# EAGLE schematic Resistor_Resistor (EAGLE 8.3.0), part 23 of 43
## Parts (continued)
R31538  10K  RESISTOR_0201  [0201]
R31539  10K  RESISTOR_0201  [0201]
R31540  10K  RESISTOR_0201  [0201]
R31541  10K  RESISTOR_0201  [0201]
R31542  10K  RESISTOR_0201  [0201]
R31543  10K  RESISTOR_0201  [0201]
R31544  10K  RESISTOR_0201  [0201]
R31545  10K  RESISTOR_0201  [0201]
R31546  10K  RESISTOR_0201  [0201]
R31547  10K  RESISTOR_0201  [0201]
R31548  10K  RESISTOR_0201  [0201]
R31549  10K  RESISTOR_0201  [0201]
R31550  10K  RESISTOR_0201  [0201]
R31551  10K  RESISTOR_0201  [0201]
R31552  10K  RESISTOR_0201  [0201]
R31553  10K  RESISTOR_0201  [0201]
R31554  10K  RESISTOR_0201  [0201]
R31555  10K  RESISTOR_0201  [0201]
R31556  10K  RESISTOR_0201  [0201]
R31557  10K  RESISTOR_0201  [0201]
R31558  10K  RESISTOR_0201  [0201]
R31559  10K  RESISTOR_0201  [0201]
R31560  10K  RESISTOR_0201  [0201]
R31561  10K  RESISTOR_0201  [0201]
R31562  10K  RESISTOR_0201  [0201]
R31563  10K  RESISTOR_0201  [0201]
R31564  10K  RESISTOR_0201  [0201]
R31565  10K  RESISTOR_0201  [0201]
R31566  10K  RESISTOR_0201  [0201]
R31567  10K  RESISTOR_0201  [0201]
R31568  10K  RESISTOR_0201  [0201]
R31569  10K  RESISTOR_0201  [0201]
R31570  10K  RESISTOR_0201  [0201]
R31571  10K  RESISTOR_0201  [0201]
R31572  10K  RESISTOR_0201  [0201]
R31573  10K  RESISTOR_0201  [0201]
R31574  10K  RESISTOR_0201  [0201]
R31575  10K  RESISTOR_0201  [0201]
R31576  10K  RESISTOR_0201  [0201]
R31577  10K  RESISTOR_0201  [0201]
R31578  10K  RESISTOR_0201  [0201]
R31579  10K  RESISTOR_0201  [0201]
R31580  10K  RESISTOR_0201  [0201]
R31581  10K  RESISTOR_0201  [0201]
R31582  10K  RESISTOR_0201  [0201]
R31583  10K  RESISTOR_0201  [0201]
R31584  10K  RESISTOR_0201  [0201]
R31585  10K  RESISTOR_0201  [0201]
R31586  10K  RESISTOR_0201  [0201]
R31587  10K  RESISTOR_0201  [0201]
R31588  10K  RESISTOR_0201  [0201]
R31589  10K  RESISTOR_0201  [0201]
R31590  10K  RESISTOR_0201  [0201]
R31591  10K  RESISTOR_0201  [0201]
R31592  10K  RESISTOR_0201  [0201]
R31593  10K  RESISTOR_0201  [0201]
R31594  10K  RESISTOR_0201  [0201]
R31595  10K  RESISTOR_0201  [0201]
R31596  10K  RESISTOR_0201  [0201]
R31597  10K  RESISTOR_0201  [0201]
R31598  10K  RESISTOR_0201  [0201]
R31599  10K  RESISTOR_0201  [0201]
R31600  10K  RESISTOR_0201  [0201]
R31601  10K  RESISTOR_0201  [0201]
R31602  10K  RESISTOR_0201  [0201]
R31603  10K  RESISTOR_0201  [0201]
R31604  10K  RESISTOR_0201  [0201]
R31605  10K  RESISTOR_0201  [0201]
R31606  10K  RESISTOR_0201  [0201]
R31607  10K  RESISTOR_0201  [0201]
R31608  10K  RESISTOR_0201  [0201]
R31609  10K  RESISTOR_0201  [0201]
R31610  10K  RESISTOR_0201  [0201]
R31611  10K  RESISTOR_0201  [0201]
R31612  10K  RESISTOR_0201  [0201]
R31613  10K  RESISTOR_0201  [0201]
R31614  10K  RESISTOR_0201  [0201]
R31615  10K  RESISTOR_0201  [0201]
R31616  10K  RESISTOR_0201  [0201]
R31617  10K  RESISTOR_0201  [0201]
R31618  10K  RESISTOR_0201  [0201]
R31619  10K  RESISTOR_0201  [0201]
R31620  10K  RESISTOR_0201  [0201]
R31621  10K  RESISTOR_0201  [0201]
R31622  10K  RESISTOR_0201  [0201]
R31623  10K  RESISTOR_0201  [0201]
R31624  10K  RESISTOR_0201  [0201]
R31625  10K  RESISTOR_0201  [0201]
R31626  10K  RESISTOR_0201  [0201]
R31627  10K  RESISTOR_0201  [0201]
R31628  10K  RESISTOR_0201  [0201]
R31629  10K  RESISTOR_0201  [0201]
R31630  10K  RESISTOR_0201  [0201]
R31631  10K  RESISTOR_0201  [0201]
R31632  10K  RESISTOR_0201  [0201]
R31633  10K  RESISTOR_0201  [0201]
R31634  10K  RESISTOR_0201  [0201]
R31635  10K  RESISTOR_0201  [0201]
R31636  10K  RESISTOR_0201  [0201]
R31637  10K  RESISTOR_0201  [0201]
R31638  10K  RESISTOR_0201  [0201]
R31639  10K  RESISTOR_0201  [0201]
R31640  10K  RESISTOR_0201  [0201]
R31641  10K  RESISTOR_0201  [0201]
R31642  10K  RESISTOR_0201  [0201]
R31643  10K  RESISTOR_0201  [0201]
R31644  10K  RESISTOR_0201  [0201]
R31645  10K  RESISTOR_0201  [0201]
R31646  10K  RESISTOR_0201  [0201]
R31647  10K  RESISTOR_0201  [0201]
R31648  10K  RESISTOR_0201  [0201]
R31649  10K  RESISTOR_0201  [0201]
R31650  10K  RESISTOR_0201  [0201]
R31651  10K  RESISTOR_0201  [0201]
R31652  10K  RESISTOR_0201  [0201]
R31653  10K  RESISTOR_0201  [0201]
R31654  10K  RESISTOR_0201  [0201]
R31655  10K  RESISTOR_0201  [0201]
R31656  10K  RESISTOR_0201  [0201]
R31657  10K  RESISTOR_0201  [0201]
R31658  10K  RESISTOR_0201  [0201]
R31659  10K  RESISTOR_0201  [0201]
R31660  10K  RESISTOR_0201  [0201]
R31661  10K  RESISTOR_0201  [0201]
R31662  10K  RESISTOR_0201  [0201]
R31663  10K  RESISTOR_0201  [0201]
R31664  10K  RESISTOR_0201  [0201]
R31665  10K  RESISTOR_0201  [0201]
R31666  10K  RESISTOR_0201  [0201]
R31667  10K  RESISTOR_0201  [0201]
R31668  10K  RESISTOR_0201  [0201]
R31669  10K  RESISTOR_0201  [0201]
R31670  10K  RESISTOR_0201  [0201]
R31671  10K  RESISTOR_0201  [0201]
R31672  10K  RESISTOR_0201  [0201]
R31673  10K  RESISTOR_0201  [0201]
R31674  10K  RESISTOR_0201  [0201]
R31675  10K  RESISTOR_0201  [0201]
R31676  10K  RESISTOR_0201  [0201]
R31677  10K  RESISTOR_0201  [0201]
R31678  10K  RESISTOR_0201  [0201]
R31679  10K  RESISTOR_0201  [0201]
R31680  10K  RESISTOR_0201  [0201]
R31681  10K  RESISTOR_0201  [0201]
R31682  10K  RESISTOR_0201  [0201]
R31683  10K  RESISTOR_0201  [0201]
R31684  10K  RESISTOR_0201  [0201]
R31685  10K  RESISTOR_0201  [0201]
R31686  10K  RESISTOR_0201  [0201]
R31687  10K  RESISTOR_0201  [0201]
R31688  10K  RESISTOR_0201  [0201]
R31689  10K  RESISTOR_0201  [0201]
R31690  10K  RESISTOR_0201  [0201]
R31691  10K  RESISTOR_0201  [0201]
R31692  10K  RESISTOR_0201  [0201]
R31693  10K  RESISTOR_0201  [0201]
R31694  10K  RESISTOR_0201  [0201]
R31695  10K  RESISTOR_0201  [0201]
R31696  10K  RESISTOR_0201  [0201]
R31697  10K  RESISTOR_0201  [0201]
R31698  10K  RESISTOR_0201  [0201]
R31699  10K  RESISTOR_0201  [0201]
R31700  10K  RESISTOR_0201  [0201]
R31701  10K  RESISTOR_0201  [0201]
R31702  10K  RESISTOR_0201  [0201]
R31703  10K  RESISTOR_0201  [0201]
R31704  10K  RESISTOR_0201  [0201]
R31705  10K  RESISTOR_0201  [0201]
R31706  10K  RESISTOR_0201  [0201]
R31707  10K  RESISTOR_0201  [0201]
R31708  10K  RESISTOR_0201  [0201]
R31709  10K  RESISTOR_0201  [0201]
R31710  10K  RESISTOR_0201  [0201]
R31711  10K  RESISTOR_0201  [0201]
R31712  10K  RESISTOR_0201  [0201]
R31713  10K  RESISTOR_0201  [0201]
R31714  10K  RESISTOR_0201  [0201]
R31715  10K  RESISTOR_0201  [0201]
R31716  10K  RESISTOR_0201  [0201]
R31717  10K  RESISTOR_0201  [0201]
R31718  10K  RESISTOR_0201  [0201]
R31719  10K  RESISTOR_0201  [0201]
R31720  10K  RESISTOR_0201  [0201]
R31721  10K  RESISTOR_0201  [0201]
R31722  10K  RESISTOR_0201  [0201]
R31723  10K  RESISTOR_0201  [0201]
R31724  10K  RESISTOR_0201  [0201]
R31725  10K  RESISTOR_0201  [0201]
R31726  10K  RESISTOR_0201  [0201]
R31727  10K  RESISTOR_0201  [0201]
R31728  10K  RESISTOR_0201  [0201]
R31729  10K  RESISTOR_0201  [0201]
R31730  10K  RESISTOR_0201  [0201]
R31731  10K  RESISTOR_0201  [0201]
R31732  10K  RESISTOR_0201  [0201]
R31733  10K  RESISTOR_0201  [0201]
R31734  10K  RESISTOR_0201  [0201]
R31735  10K  RESISTOR_0201  [0201]
R31736  10K  RESISTOR_0201  [0201]
R31737  10K  RESISTOR_0201  [0201]
R31738  10K  RESISTOR_0201  [0201]
R31739  10K  RESISTOR_0201  [0201]
R31740  10K  RESISTOR_0201  [0201]
R31741  10K  RESISTOR_0201  [0201]
R31742  10K  RESISTOR_0201  [0201]
R31743  10K  RESISTOR_0201  [0201]
R31744  10K  RESISTOR_0201  [0201]
R31745  10K  RESISTOR_0201  [0201]
R31746  10K  RESISTOR_0201  [0201]
R31747  10K  RESISTOR_0201  [0201]
R31748  10K  RESISTOR_0201  [0201]
R31749  10K  RESISTOR_0201  [0201]
R31750  10K  RESISTOR_0201  [0201]
R31751  10K  RESISTOR_0201  [0201]
R31752  10K  RESISTOR_0201  [0201]
R31753  10K  RESISTOR_0201  [0201]
R31754  10K  RESISTOR_0201  [0201]
R31755  10K  RESISTOR_0201  [0201]
R31756  10K  RESISTOR_0201  [0201]
R31757  10K  RESISTOR_0201  [0201]
R31758  10K  RESISTOR_0201  [0201]
R31759  10K  RESISTOR_0201  [0201]
R31760  10K  RESISTOR_0201  [0201]
R31761  10K  RESISTOR_0201  [0201]
R31762  10K  RESISTOR_0201  [0201]
R31763  10K  RESISTOR_0201  [0201]
R31764  10K  RESISTOR_0201  [0201]
R31765  10K  RESISTOR_0201  [0201]
R31766  10K  RESISTOR_0201  [0201]
R31767  10K  RESISTOR_0201  [0201]
R31768  10K  RESISTOR_0201  [0201]
R31769  10K  RESISTOR_0201  [0201]
R31770  10K  RESISTOR_0201  [0201]
R31771  10K  RESISTOR_0201  [0201]
R31772  10K  RESISTOR_0201  [0201]
R31773  10K  RESISTOR_0201  [0201]
R31774  10K  RESISTOR_0201  [0201]
R31775  10K  RESISTOR_0201  [0201]
R31776  10K  RESISTOR_0201  [0201]
R31777  10K  RESISTOR_0201  [0201]
R31778  10K  RESISTOR_0201  [0201]
R31779  10K  RESISTOR_0201  [0201]
R31780  10K  RESISTOR_0201  [0201]
R31781  10K  RESISTOR_0201  [0201]
R31782  10K  RESISTOR_0201  [0201]
R31783  10K  RESISTOR_0201  [0201]
R31784  10K  RESISTOR_0201  [0201]
R31785  10K  RESISTOR_0201  [0201]
R31786  10K  RESISTOR_0201  [0201]
R31787  10K  RESISTOR_0201  [0201]
R31788  10K  RESISTOR_0201  [0201]
R31789  10K  RESISTOR_0201  [0201]
R31790  10K  RESISTOR_0201  [0201]
R31791  10K  RESISTOR_0201  [0201]
R31792  10K  RESISTOR_0201  [0201]
R31793  10K  RESISTOR_0201  [0201]
R31794  10K  RESISTOR_0201  [0201]
R31795  10K  RESISTOR_0201  [0201]
R31796  10K  RESISTOR_0201  [0201]
R31797  10K  RESISTOR_0201  [0201]
R31798  10K  RESISTOR_0201  [0201]
R31799  10K  RESISTOR_0201  [0201]
R31800  10K  RESISTOR_0201  [0201]
R31801  10K  RESISTOR_0201  [0201]
R31802  10K  RESISTOR_0201  [0201]
R31803  10K  RESISTOR_0201  [0201]
R31804  10K  RESISTOR_0201  [0201]
R31805  10K  RESISTOR_0201  [0201]
R31806  10K  RESISTOR_0201  [0201]
R31807  10K  RESISTOR_0201  [0201]
R31808  10K  RESISTOR_0201  [0201]
R31809  10K  RESISTOR_0201  [0201]
R31810  10K  RESISTOR_0201  [0201]
R31811  10K  RESISTOR_0201  [0201]
R31812  10K  RESISTOR_0201  [0201]
R31813  10K  RESISTOR_0201  [0201]
R31814  10K  RESISTOR_0201  [0201]
R31815  10K  RESISTOR_0201  [0201]
R31816  10K  RESISTOR_0201  [0201]
R31817  10K  RESISTOR_0201  [0201]
R31818  10K  RESISTOR_0201  [0201]
R31819  10K  RESISTOR_0201  [0201]
R31820  10K  RESISTOR_0201  [0201]
R31821  10K  RESISTOR_0201  [0201]
R31822  10K  RESISTOR_0201  [0201]
R31823  10K  RESISTOR_0201  [0201]
R31824  10K  RESISTOR_0201  [0201]
R31825  10K  RESISTOR_0201  [0201]
R31826  10K  RESISTOR_0201  [0201]
R31827  10K  RESISTOR_0201  [0201]
R31828  10K  RESISTOR_0201  [0201]
R31829  10K  RESISTOR_0201  [0201]
R31830  10K  RESISTOR_0201  [0201]
R31831  10K  RESISTOR_0201  [0201]
R31832  10K  RESISTOR_0201  [0201]
R31833  10K  RESISTOR_0201  [0201]
R31834  10K  RESISTOR_0201  [0201]
R31835  10K  RESISTOR_0201  [0201]
R31836  10K  RESISTOR_0201  [0201]
R31837  10K  RESISTOR_0201  [0201]
R31838  10K  RESISTOR_0201  [0201]
R31839  10K  RESISTOR_0201  [0201]
R31840  10K  RESISTOR_0201  [0201]
R31841  10K  RESISTOR_0201  [0201]
R31842  10K  RESISTOR_0201  [0201]
R31843  10K  RESISTOR_0201  [0201]
R31844  10K  RESISTOR_0201  [0201]
R31845  10K  RESISTOR_0201  [0201]
R31846  10K  RESISTOR_0201  [0201]
R31847  10K  RESISTOR_0201  [0201]
R31848  10K  RESISTOR_0201  [0201]
R31849  10K  RESISTOR_0201  [0201]
R31850  10K  RESISTOR_0201  [0201]
R31851  10K  RESISTOR_0201  [0201]
R31852  10K  RESISTOR_0201  [0201]
R31853  10K  RESISTOR_0201  [0201]
R31854  10K  RESISTOR_0201  [0201]
R31855  10K  RESISTOR_0201  [0201]
R31856  10K  RESISTOR_0201  [0201]
R31857  10K  RESISTOR_0201  [0201]
R31858  10K  RESISTOR_0201  [0201]
R31859  10K  RESISTOR_0201  [0201]
R31860  10K  RESISTOR_0201  [0201]
R31861  10K  RESISTOR_0201  [0201]
R31862  10K  RESISTOR_0201  [0201]
R31863  10K  RESISTOR_0201  [0201]
R31864  10K  RESISTOR_0201  [0201]
R31865  10K  RESISTOR_0201  [0201]
R31866  10K  RESISTOR_0201  [0201]
R31867  10K  RESISTOR_0201  [0201]
R31868  10K  RESISTOR_0201  [0201]
R31869  10K  RESISTOR_0201  [0201]
R31870  10K  RESISTOR_0201  [0201]
R31871  10K  RESISTOR_0201  [0201]
R31872  10K  RESISTOR_0201  [0201]
R31873  10K  RESISTOR_0201  [0201]
R31874  10K  RESISTOR_0201  [0201]
R31875  10K  RESISTOR_0201  [0201]
R31876  10K  RESISTOR_0201  [0201]
R31877  10K  RESISTOR_0201  [0201]
R31878  10K  RESISTOR_0201  [0201]
R31879  10K  RESISTOR_0201  [0201]
R31880  10K  RESISTOR_0201  [0201]
R31881  10K  RESISTOR_0201  [0201]
R31882  10K  RESISTOR_0201  [0201]
R31883  10K  RESISTOR_0201  [0201]
R31884  10K  RESISTOR_0201  [0201]
R31885  10K  RESISTOR_0201  [0201]
R31886  10K  RESISTOR_0201  [0201]
R31887  10K  RESISTOR_0201  [0201]
R31888  10K  RESISTOR_0201  [0201]
R31889  10K  RESISTOR_0201  [0201]
R31890  10K  RESISTOR_0201  [0201]
R31891  10K  RESISTOR_0201  [0201]
R31892  10K  RESISTOR_0201  [0201]
R31893  10K  RESISTOR_0201  [0201]
R31894  10K  RESISTOR_0201  [0201]
R31895  10K  RESISTOR_0201  [0201]
R31896  10K  RESISTOR_0201  [0201]
R31897  10K  RESISTOR_0201  [0201]
R31898  10K  RESISTOR_0201  [0201]
R31899  10K  RESISTOR_0201  [0201]
R31900  10K  RESISTOR_0201  [0201]
R31901  10K  RESISTOR_0201  [0201]
R31902  10K  RESISTOR_0201  [0201]
R31903  10K  RESISTOR_0201  [0201]
R31904  10K  RESISTOR_0201  [0201]
R31905  10K  RESISTOR_0201  [0201]
R31906  10K  RESISTOR_0201  [0201]
R31907  10K  RESISTOR_0201  [0201]
R31908  10K  RESISTOR_0201  [0201]
R31909  10K  RESISTOR_0201  [0201]
R31910  10K  RESISTOR_0201  [0201]
R31911  10K  RESISTOR_0201  [0201]
R31912  10K  RESISTOR_0201  [0201]
R31913  10K  RESISTOR_0201  [0201]
R31914  10K  RESISTOR_0201  [0201]
R31915  10K  RESISTOR_0201  [0201]
R31916  10K  RESISTOR_0201  [0201]
R31917  10K  RESISTOR_0201  [0201]
R31918  10K  RESISTOR_0201  [0201]
R31919  10K  RESISTOR_0201  [0201]
R31920  10K  RESISTOR_0201  [0201]
R31921  10K  RESISTOR_0201  [0201]
R31922  10K  RESISTOR_0201  [0201]
R31923  10K  RESISTOR_0201  [0201]
R31924  10K  RESISTOR_0201  [0201]
R31925  10K  RESISTOR_0201  [0201]
R31926  10K  RESISTOR_0201  [0201]
R31927  10K  RESISTOR_0201  [0201]
R31928  10K  RESISTOR_0201  [0201]
R31929  10K  RESISTOR_0201  [0201]
R31930  10K  RESISTOR_0201  [0201]
R31931  10K  RESISTOR_0201  [0201]
R31932  10K  RESISTOR_0201  [0201]
R31933  10K  RESISTOR_0201  [0201]
R31934  10K  RESISTOR_0201  [0201]
R31935  10K  RESISTOR_0201  [0201]
R31936  10K  RESISTOR_0201  [0201]
R31937  10K  RESISTOR_0201  [0201]
R31938  10K  RESISTOR_0201  [0201]
R31939  10K  RESISTOR_0201  [0201]
R31940  10K  RESISTOR_0201  [0201]
R31941  10K  RESISTOR_0201  [0201]
R31942  10K  RESISTOR_0201  [0201]
R31943  10K  RESISTOR_0201  [0201]
R31944  10K  RESISTOR_0201  [0201]
R31945  10K  RESISTOR_0201  [0201]
R31946  10K  RESISTOR_0201  [0201]
R31947  10K  RESISTOR_0201  [0201]
R31948  10K  RESISTOR_0201  [0201]
R31949  10K  RESISTOR_0201  [0201]
R31950  10K  RESISTOR_0201  [0201]
R31951  10K  RESISTOR_0201  [0201]
R31952  10K  RESISTOR_0201  [0201]
R31953  10K  RESISTOR_0201  [0201]
R31954  10K  RESISTOR_0201  [0201]
R31955  10K  RESISTOR_0201  [0201]
R31956  10K  RESISTOR_0201  [0201]
R31957  10K  RESISTOR_0201  [0201]
R31958  10K  RESISTOR_0201  [0201]
R31959  10K  RESISTOR_0201  [0201]
R31960  10K  RESISTOR_0201  [0201]
R31961  10K  RESISTOR_0201  [0201]
R31962  10K  RESISTOR_0201  [0201]
R31963  10K  RESISTOR_0201  [0201]
R31964  10K  RESISTOR_0201  [0201]
R31965  10K  RESISTOR_0201  [0201]
R31966  10K  RESISTOR_0201  [0201]
R31967  10K  RESISTOR_0201  [0201]
R31968  10K  RESISTOR_0201  [0201]
R31969  10K  RESISTOR_0201  [0201]
R31970  10K  RESISTOR_0201  [0201]
R31971  10K  RESISTOR_0201  [0201]
R31972  10K  RESISTOR_0201  [0201]
R31973  10K  RESISTOR_0201  [0201]
R31974  10K  RESISTOR_0201  [0201]
R31975  10K  RESISTOR_0201  [0201]
R31976  10K  RESISTOR_0201  [0201]
R31977  10K  RESISTOR_0201  [0201]
R31978  10K  RESISTOR_0201  [0201]
R31979  10K  RESISTOR_0201  [0201]
R31980  10K  RESISTOR_0201  [0201]
R31981  10K  RESISTOR_0201  [0201]
R31982  10K  RESISTOR_0201  [0201]
R31983  10K  RESISTOR_0201  [0201]
R31984  10K  RESISTOR_0201  [0201]
R31985  10K  RESISTOR_0201  [0201]
R31986  10K  RESISTOR_0201  [0201]
R31987  10K  RESISTOR_0201  [0201]
R31988  10K  RESISTOR_0201  [0201]
R31989  10K  RESISTOR_0201  [0201]
R31990  10K  RESISTOR_0201  [0201]
R31991  10K  RESISTOR_0201  [0201]
R31992  10K  RESISTOR_0201  [0201]
R31993  10K  RESISTOR_0201  [0201]
R31994  10K  RESISTOR_0201  [0201]
R31995  10K  RESISTOR_0201  [0201]
R31996  10K  RESISTOR_0201  [0201]
R31997  10K  RESISTOR_0201  [0201]
R31998  10K  RESISTOR_0201  [0201]
R31999  10K  RESISTOR_0201  [0201]
R32000  10K  RESISTOR_0201  [0201]
R32001  10K  RESISTOR_0201  [0201]
R32002  10K  RESISTOR_0201  [0201]
R32003  10K  RESISTOR_0201  [0201]
R32004  10K  RESISTOR_0201  [0201]
R32005  10K  RESISTOR_0201  [0201]
R32006  10K  RESISTOR_0201  [0201]
R32007  10K  RESISTOR_0201  [0201]
R32008  10K  RESISTOR_0201  [0201]
R32009  10K  RESISTOR_0201  [0201]
R32010  10K  RESISTOR_0201  [0201]
R32011  10K  RESISTOR_0201  [0201]
R32012  10K  RESISTOR_0201  [0201]
R32013  10K  RESISTOR_0201  [0201]
R32014  10K  RESISTOR_0201  [0201]
R32015  10K  RESISTOR_0201  [0201]
R32016  10K  RESISTOR_0201  [0201]
R32017  10K  RESISTOR_0201  [0201]
R32018  10K  RESISTOR_0201  [0201]
R32019  10K  RESISTOR_0201  [0201]
R32020  10K  RESISTOR_0201  [0201]
R32021  10K  RESISTOR_0201  [0201]
R32022  10K  RESISTOR_0201  [0201]
R32023  10K  RESISTOR_0201  [0201]
R32024  10K  RESISTOR_0201  [0201]
R32025  10K  RESISTOR_0201  [0201]
R32026  10K  RESISTOR_0201  [0201]
R32027  10K  RESISTOR_0201  [0201]
R32028  10K  RESISTOR_0201  [0201]
R32029  10K  RESISTOR_0201  [0201]
R32030  10K  RESISTOR_0201  [0201]
R32031  10K  RESISTOR_0201  [0201]
R32032  10K  RESISTOR_0201  [0201]
R32033  10K  RESISTOR_0201  [0201]
R32034  10K  RESISTOR_0201  [0201]
R32035  10K  RESISTOR_0201  [0201]
R32036  10K  RESISTOR_0201  [0201]
R32037  10K  RESISTOR_0201  [0201]
R32038  10K  RESISTOR_0201  [0201]
R32039  10K  RESISTOR_0201  [0201]
R32040  10K  RESISTOR_0201  [0201]
R32041  10K  RESISTOR_0201  [0201]
R32042  10K  RESISTOR_0201  [0201]
R32043  10K  RESISTOR_0201  [0201]
R32044  10K  RESISTOR_0201  [0201]
R32045  10K  RESISTOR_0201  [0201]
R32046  10K  RESISTOR_0201  [0201]
R32047  10K  RESISTOR_0201  [0201]
R32048  10K  RESISTOR_0201  [0201]
R32049  10K  RESISTOR_0201  [0201]
R32050  10K  RESISTOR_0201  [0201]
R32051  10K  RESISTOR_0201  [0201]
R32052  10K  RESISTOR_0201  [0201]
R32053  10K  RESISTOR_0201  [0201]
R32054  10K  RESISTOR_0201  [0201]
R32055  10K  RESISTOR_0201  [0201]
R32056  10K  RESISTOR_0201  [0201]
R32057  10K  RESISTOR_0201  [0201]
R32058  10K  RESISTOR_0201  [0201]
R32059  10K  RESISTOR_0201  [0201]
R32060  10K  RESISTOR_0201  [0201]
R32061  10K  RESISTOR_0201  [0201]
R32062  10K  RESISTOR_0201  [0201]
R32063  10K  RESISTOR_0201  [0201]
R32064  10K  RESISTOR_0201  [0201]
R32065  10K  RESISTOR_0201  [0201]
R32066  10K  RESISTOR_0201  [0201]
R32067  10K  RESISTOR_0201  [0201]
R32068  10K  RESISTOR_0201  [0201]
R32069  10K  RESISTOR_0201  [0201]
R32070  10K  RESISTOR_0201  [0201]
R32071  10K  RESISTOR_0201  [0201]
R32072  10K  RESISTOR_0201  [0201]
R32073  10K  RESISTOR_0201  [0201]
R32074  10K  RESISTOR_0201  [0201]
R32075  10K  RESISTOR_0201  [0201]
R32076  10K  RESISTOR_0201  [0201]
R32077  10K  RESISTOR_0201  [0201]
R32078  10K  RESISTOR_0201  [0201]
R32079  10K  RESISTOR_0201  [0201]
R32080  10K  RESISTOR_0201  [0201]
R32081  10K  RESISTOR_0201  [0201]
R32082  10K  RESISTOR_0201  [0201]
R32083  10K  RESISTOR_0201  [0201]
R32084  10K  RESISTOR_0201  [0201]
R32085  10K  RESISTOR_0201  [0201]
R32086  10K  RESISTOR_0201  [0201]
R32087  10K  RESISTOR_0201  [0201]
R32088  10K  RESISTOR_0201  [0201]
R32089  10K  RESISTOR_0201  [0201]
R32090  10K  RESISTOR_0201  [0201]
R32091  10K  RESISTOR_0201  [0201]
R32092  10K  RESISTOR_0201  [0201]
R32093  10K  RESISTOR_0201  [0201]
R32094  10K  RESISTOR_0201  [0201]
R32095  10K  RESISTOR_0201  [0201]
R32096  10K  RESISTOR_0201  [0201]
R32097  10K  RESISTOR_0201  [0201]
R32098  10K  RESISTOR_0201  [0201]
R32099  10K  RESISTOR_0201  [0201]
R32100  10K  RESISTOR_0201  [0201]
R32101  10K  RESISTOR_0201  [0201]
R32102  10K  RESISTOR_0201  [0201]
R32103  10K  RESISTOR_0201  [0201]
R32104  10K  RESISTOR_0201  [0201]
R32105  10K  RESISTOR_0201  [0201]
R32106  10K  RESISTOR_0201  [0201]
R32107  10K  RESISTOR_0201  [0201]
R32108  10K  RESISTOR_0201  [0201]
R32109  10K  RESISTOR_0201  [0201]
R32110  10K  RESISTOR_0201  [0201]
R32111  10K  RESISTOR_0201  [0201]
R32112  10K  RESISTOR_0201  [0201]
R32113  10K  RESISTOR_0201  [0201]
R32114  10K  RESISTOR_0201  [0201]
R32115  10K  RESISTOR_0201  [0201]
R32116  10K  RESISTOR_0201  [0201]
R32117  10K  RESISTOR_0201  [0201]
R32118  10K  RESISTOR_0201  [0201]
R32119  10K  RESISTOR_0201  [0201]
R32120  10K  RESISTOR_0201  [0201]
R32121  10K  RESISTOR_0201  [0201]
R32122  10K  RESISTOR_0201  [0201]
R32123  10K  RESISTOR_0201  [0201]
R32124  10K  RESISTOR_0201  [0201]
R32125  10K  RESISTOR_0201  [0201]
R32126  10K  RESISTOR_0201  [0201]
R32127  10K  RESISTOR_0201  [0201]
R32128  10K  RESISTOR_0201  [0201]
R32129  10K  RESISTOR_0201  [0201]
R32130  10K  RESISTOR_0201  [0201]
R32131  10K  RESISTOR_0201  [0201]
R32132  10K  RESISTOR_0201  [0201]
R32133  10K  RESISTOR_0201  [0201]
R32134  10K  RESISTOR_0201  [0201]
R32135  10K  RESISTOR_0201  [0201]
R32136  10K  RESISTOR_0201  [0201]
R32137  10K  RESISTOR_0201  [0201]
R32138  10K  RESISTOR_0201  [0201]
R32139  10K  RESISTOR_0201  [0201]
R32140  10K  RESISTOR_0201  [0201]
R32141  10K  RESISTOR_0201  [0201]
R32142  10K  RESISTOR_0201  [0201]
R32143  10K  RESISTOR_0201  [0201]
R32144  10K  RESISTOR_0201  [0201]
R32145  10K  RESISTOR_0201  [0201]
R32146  10K  RESISTOR_0201  [0201]
R32147  10K  RESISTOR_0201  [0201]
R32148  10K  RESISTOR_0201  [0201]
R32149  10K  RESISTOR_0201  [0201]
R32150  10K  RESISTOR_0201  [0201]
R32151  10K  RESISTOR_0201  [0201]
R32152  10K  RESISTOR_0201  [0201]
R32153  10K  RESISTOR_0201  [0201]
R32154  10K  RESISTOR_0201  [0201]
R32155  10K  RESISTOR_0201  [0201]
R32156  10K  RESISTOR_0201  [0201]
R32157  10K  RESISTOR_0201  [0201]
R32158  10K  RESISTOR_0201  [0201]
R32159  10K  RESISTOR_0201  [0201]
R32160  10K  RESISTOR_0201  [0201]
R32161  10K  RESISTOR_0201  [0201]
R32162  10K  RESISTOR_0201  [0201]
R32163  10K  RESISTOR_0201  [0201]
R32164  10K  RESISTOR_0201  [0201]
R32165  10K  RESISTOR_0201  [0201]
R32166  10K  RESISTOR_0201  [0201]
R32167  10K  RESISTOR_0201  [0201]
R32168  10K  RESISTOR_0201  [0201]
R32169  10K  RESISTOR_0201  [0201]
R32170  10K  RESISTOR_0201  [0201]
R32171  10K  RESISTOR_0201  [0201]
R32172  10K  RESISTOR_0201  [0201]
R32173  10K  RESISTOR_0201  [0201]
R32174  10K  RESISTOR_0201  [0201]
R32175  10K  RESISTOR_0201  [0201]
R32176  10K  RESISTOR_0201  [0201]
R32177  10K  RESISTOR_0201  [0201]
R32178  10K  RESISTOR_0201  [0201]
R32179  10K  RESISTOR_0201  [0201]
R32180  10K  RESISTOR_0201  [0201]
R32181  10K  RESISTOR_0201  [0201]
R32182  10K  RESISTOR_0201  [0201]
R32183  10K  RESISTOR_0201  [0201]
R32184  10K  RESISTOR_0201  [0201]
R32185  10K  RESISTOR_0201  [0201]
R32186  10K  RESISTOR_0201  [0201]
R32187  10K  RESISTOR_0201  [0201]
R32188  10K  RESISTOR_0201  [0201]
R32189  10K  RESISTOR_0201  [0201]
R32190  10K  RESISTOR_0201  [0201]
R32191  10K  RESISTOR_0201  [0201]
R32192  10K  RESISTOR_0201  [0201]
R32193  10K  RESISTOR_0201  [0201]
R32194  10K  RESISTOR_0201  [0201]
R32195  10K  RESISTOR_0201  [0201]
R32196  10K  RESISTOR_0201  [0201]
R32197  10K  RESISTOR_0201  [0201]
R32198  10K  RESISTOR_0201  [0201]
R32199  10K  RESISTOR_0201  [0201]
R32200  10K  RESISTOR_0201  [0201]
R32201  10K  RESISTOR_0201  [0201]
R32202  10K  RESISTOR_0201  [0201]
R32203  10K  RESISTOR_0201  [0201]
R32204  10K  RESISTOR_0201  [0201]
R32205  10K  RESISTOR_0201  [0201]
R32206  10K  RESISTOR_0201  [0201]
R32207  10K  RESISTOR_0201  [0201]
R32208  10K  RESISTOR_0201  [0201]
R32209  10K  RESISTOR_0201  [0201]
R32210  10K  RESISTOR_0201  [0201]
R32211  10K  RESISTOR_0201  [0201]
R32212  10K  RESISTOR_0201  [0201]
R32213  10K  RESISTOR_0201  [0201]
R32214  10K  RESISTOR_0201  [0201]
R32215  10K  RESISTOR_0201  [0201]
R32216  10K  RESISTOR_0201  [0201]
R32217  10K  RESISTOR_0201  [0201]
R32218  10K  RESISTOR_0201  [0201]
R32219  10K  RESISTOR_0201  [0201]
R32220  10K  RESISTOR_0201  [0201]
R32221  10K  RESISTOR_0201  [0201]
R32222  10K  RESISTOR_0201  [0201]
R32223  10K  RESISTOR_0201  [0201]
R32224  10K  RESISTOR_0201  [0201]
R32225  10K  RESISTOR_0201  [0201]
R32226  10K  RESISTOR_0201  [0201]
R32227  10K  RESISTOR_0201  [0201]
R32228  10K  RESISTOR_0201  [0201]
R32229  10K  RESISTOR_0201  [0201]
R32230  10K  RESISTOR_0201  [0201]
R32231  10K  RESISTOR_0201  [0201]
R32232  10K  RESISTOR_0201  [0201]
R32233  10K  RESISTOR_0201  [0201]
R32234  10K  RESISTOR_0201  [0201]
R32235  10K  RESISTOR_0201  [0201]
R32236  10K  RESISTOR_0201  [0201]
R32237  10K  RESISTOR_0201  [0201]
R32238  10K  RESISTOR_0201  [0201]
R32239  10K  RESISTOR_0201  [0201]
R32240  10K  RESISTOR_0201  [0201]
R32241  10K  RESISTOR_0201  [0201]
R32242  10K  RESISTOR_0201  [0201]
R32243  10K  RESISTOR_0201  [0201]
R32244  10K  RESISTOR_0201  [0201]
R32245  10K  RESISTOR_0201  [0201]
R32246  10K  RESISTOR_0201  [0201]
R32247  10K  RESISTOR_0201  [0201]
R32248  10K  RESISTOR_0201  [0201]
R32249  10K  RESISTOR_0201  [0201]
R32250  10K  RESISTOR_0201  [0201]
R32251  10K  RESISTOR_0201  [0201]
R32252  10K  RESISTOR_0201  [0201]
R32253  10K  RESISTOR_0201  [0201]
R32254  10K  RESISTOR_0201  [0201]
R32255  10K  RESISTOR_0201  [0201]
R32256  10K  RESISTOR_0201  [0201]
R32257  10K  RESISTOR_0201  [0201]
R32258  10K  RESISTOR_0201  [0201]
R32259  10K  RESISTOR_0201  [0201]
R32260  10K  RESISTOR_0201  [0201]
R32261  10K  RESISTOR_0201  [0201]
R32262  10K  RESISTOR_0201  [0201]
R32263  10K  RESISTOR_0201  [0201]
R32264  10K  RESISTOR_0201  [0201]
R32265  10K  RESISTOR_0201  [0201]
R32266  10K  RESISTOR_0201  [0201]
R32267  10K  RESISTOR_0201  [0201]
R32268  10K  RESISTOR_0201  [0201]
R32269  10K  RESISTOR_0201  [0201]
R32270  10K  RESISTOR_0201  [0201]
R32271  10K  RESISTOR_0201  [0201]
R32272  10K  RESISTOR_0201  [0201]
R32273  10K  RESISTOR_0201  [0201]
R32274  10K  RESISTOR_0201  [0201]
R32275  10K  RESISTOR_0201  [0201]
R32276  10K  RESISTOR_0201  [0201]
R32277  10K  RESISTOR_0201  [0201]
R32278  10K  RESISTOR_0201  [0201]
R32279  10K  RESISTOR_0201  [0201]
R32280  10K  RESISTOR_0201  [0201]
R32281  10K  RESISTOR_0201  [0201]
R32282  10K  RESISTOR_0201  [0201]
R32283  10K  RESISTOR_0201  [0201]
R32284  10K  RESISTOR_0201  [0201]
R32285  10K  RESISTOR_0201  [0201]
R32286  10K  RESISTOR_0201  [0201]
R32287  10K  RESISTOR_0201  [0201]
R32288  10K  RESISTOR_0201  [0201]
R32289  10K  RESISTOR_0201  [0201]
R32290  10K  RESISTOR_0201  [0201]
R32291  10K  RESISTOR_0201  [0201]
R32292  10K  RESISTOR_0201  [0201]
R32293  10K  RESISTOR_0201  [0201]
R32294  10K  RESISTOR_0201  [0201]
R32295  10K  RESISTOR_0201  [0201]
R32296  10K  RESISTOR_0201  [0201]
R32297  10K  RESISTOR_0201  [0201]
R32298  10K  RESISTOR_0201  [0201]
R32299  10K  RESISTOR_0201  [0201]
R32300  10K  RESISTOR_0201  [0201]
R32301  10K  RESISTOR_0201  [0201]
R32302  10K  RESISTOR_0201  [0201]
R32303  10K  RESISTOR_0201  [0201]
R32304  10K  RESISTOR_0201  [0201]
R32305  10K  RESISTOR_0201  [0201]
R32306  10K  RESISTOR_0201  [0201]
R32307  10K  RESISTOR_0201  [0201]
R32308  10K  RESISTOR_0201  [0201]
R32309  10K  RESISTOR_0201  [0201]
R32310  10K  RESISTOR_0201  [0201]
R32311  10K  RESISTOR_0201  [0201]
R32312  10K  RESISTOR_0201  [0201]
R32313  10K  RESISTOR_0201  [0201]
R32314  10K  RESISTOR_0201  [0201]
R32315  10K  RESISTOR_0201  [0201]
R32316  10K  RESISTOR_0201  [0201]
R32317  10K  RESISTOR_0201  [0201]
R32318  10K  RESISTOR_0201  [0201]
R32319  10K  RESISTOR_0201  [0201]
R32320  10K  RESISTOR_0201  [0201]
R32321  10K  RESISTOR_0201  [0201]
R32322  10K  RESISTOR_0201  [0201]
R32323  10K  RESISTOR_0201  [0201]
R32324  10K  RESISTOR_0201  [0201]
R32325  10K  RESISTOR_0201  [0201]
R32326  10K  RESISTOR_0201  [0201]
R32327  10K  RESISTOR_0201  [0201]
R32328  10K  RESISTOR_0201  [0201]
R32329  10K  RESISTOR_0201  [0201]
R32330  10K  RESISTOR_0201  [0201]
R32331  10K  RESISTOR_0201  [0201]
R32332  10K  RESISTOR_0201  [0201]
R32333  10K  RESISTOR_0201  [0201]
R32334  10K  RESISTOR_0201  [0201]
R32335  10K  RESISTOR_0201  [0201]
R32336  10K  RESISTOR_0201  [0201]
R32337  10K  RESISTOR_0201  [0201]
R32338  10K  RESISTOR_0201  [0201]
R32339  10K  RESISTOR_0201  [0201]
R32340  10K  RESISTOR_0201  [0201]
R32341  10K  RESISTOR_0201  [0201]
R32342  10K  RESISTOR_0201  [0201]
R32343  10K  RESISTOR_0201  [0201]
R32344  10K  RESISTOR_0201  [0201]
R32345  10K  RESISTOR_0201  [0201]
R32346  10K  RESISTOR_0201  [0201]
R32347  10K  RESISTOR_0201  [0201]
R32348  10K  RESISTOR_0201  [0201]
R32349  10K  RESISTOR_0201  [0201]
R32350  10K  RESISTOR_0201  [0201]
R32351  10K  RESISTOR_0201  [0201]
R32352  10K  RESISTOR_0201  [0201]
R32353  10K  RESISTOR_0201  [0201]
R32354  10K  RESISTOR_0201  [0201]
R32355  10K  RESISTOR_0201  [0201]
R32356  10K  RESISTOR_0201  [0201]
R32357  10K  RESISTOR_0201  [0201]
R32358  10K  RESISTOR_0201  [0201]
R32359  10K  RESISTOR_0201  [0201]
R32360  10K  RESISTOR_0201  [0201]
R32361  10K  RESISTOR_0201  [0201]
R32362  10K  RESISTOR_0201  [0201]
R32363  10K  RESISTOR_0201  [0201]
R32364  10K  RESISTOR_0201  [0201]
R32365  10K  RESISTOR_0201  [0201]
R32366  10K  RESISTOR_0201  [0201]
R32367  10K  RESISTOR_0201  [0201]
R32368  10K  RESISTOR_0201  [0201]
R32369  10K  RESISTOR_0201  [0201]
R32370  10K  RESISTOR_0201  [0201]
R32371  10K  RESISTOR_0201  [0201]
R32372  10K  RESISTOR_0201  [0201]
R32373  10K  RESISTOR_0201  [0201]
R32374  10K  RESISTOR_0201  [0201]
R32375  10K  RESISTOR_0201  [0201]
R32376  10K  RESISTOR_0201  [0201]
R32377  10K  RESISTOR_0201  [0201]
R32378  10K  RESISTOR_0201  [0201]
R32379  10K  RESISTOR_0201  [0201]
R32380  10K  RESISTOR_0201  [0201]
R32381  10K  RESISTOR_0201  [0201]
R32382  10K  RESISTOR_0201  [0201]
R32383  10K  RESISTOR_0201  [0201]
R32384  10K  RESISTOR_0201  [0201]
R32385  10K  RESISTOR_0201  [0201]
R32386  10K  RESISTOR_0201  [0201]
R32387  10K  RESISTOR_0201  [0201]
R32388  10K  RESISTOR_0201  [0201]
R32389  10K  RESISTOR_0201  [0201]
R32390  10K  RESISTOR_0201  [0201]
R32391  10K  RESISTOR_0201  [0201]
R32392  10K  RESISTOR_0201  [0201]
R32393  10K  RESISTOR_0201  [0201]
R32394  10K  RESISTOR_0201  [0201]
R32395  10K  RESISTOR_0201  [0201]
R32396  10K  RESISTOR_0201  [0201]
R32397  10K  RESISTOR_0201  [0201]
R32398  10K  RESISTOR_0201  [0201]
R32399  10K  RESISTOR_0201  [0201]
R32400  10K  RESISTOR_0201  [0201]
R32401  10K  RESISTOR_0201  [0201]
R32402  10K  RESISTOR_0201  [0201]
R32403  10K  RESISTOR_0201  [0201]
R32404  10K  RESISTOR_0201  [0201]
R32405  10K  RESISTOR_0201  [0201]
R32406  10K  RESISTOR_0201  [0201]
R32407  10K  RESISTOR_0201  [0201]
R32408  10K  RESISTOR_0201  [0201]
R32409  10K  RESISTOR_0201  [0201]
R32410  10K  RESISTOR_0201  [0201]
R32411  10K  RESISTOR_0201  [0201]
R32412  10K  RESISTOR_0201  [0201]
R32413  10K  RESISTOR_0201  [0201]
R32414  10K  RESISTOR_0201  [0201]
R32415  10K  RESISTOR_0201  [0201]
R32416  10K  RESISTOR_0201  [0201]
R32417  10K  RESISTOR_0201  [0201]
R32418  10K  RESISTOR_0201  [0201]
R32419  10K  RESISTOR_0201  [0201]
R32420  10K  RESISTOR_0201  [0201]
R32421  10K  RESISTOR_0201  [0201]
R32422  10K  RESISTOR_0201  [0201]
R32423  10K  RESISTOR_0201  [0201]
R32424  10K  RESISTOR_0201  [0201]
R32425  10K  RESISTOR_0201  [0201]
R32426  10K  RESISTOR_0201  [0201]
R32427  10K  RESISTOR_0201  [0201]
R32428  10K  RESISTOR_0201  [0201]
R32429  10K  RESISTOR_0201  [0201]
R32430  10K  RESISTOR_0201  [0201]
R32431  10K  RESISTOR_0201  [0201]
R32432  10K  RESISTOR_0201  [0201]
R32433  10K  RESISTOR_0201  [0201]
R32434  10K  RESISTOR_0201  [0201]
R32435  10K  RESISTOR_0201  [0201]
R32436  10K  RESISTOR_0201  [0201]
R32437  10K  RESISTOR_0201  [0201]
R32438  10K  RESISTOR_0201  [0201]
R32439  10K  RESISTOR_0201  [0201]
R32440  10K  RESISTOR_0201  [0201]
R32441  10K  RESISTOR_0201  [0201]
R32442  10K  RESISTOR_0201  [0201]
R32443  10K  RESISTOR_0201  [0201]
R32444  10K  RESISTOR_0201  [0201]
R32445  10K  RESISTOR_0201  [0201]
R32446  10K  RESISTOR_0201  [0201]
R32447  10K  RESISTOR_0201  [0201]
R32448  10K  RESISTOR_0201  [0201]
R32449  10K  RESISTOR_0201  [0201]
R32450  10K  RESISTOR_0201  [0201]
R32451  10K  RESISTOR_0201  [0201]
R32452  10K  RESISTOR_0201  [0201]
R32453  10K  RESISTOR_0201  [0201]
R32454  10K  RESISTOR_0201  [0201]
R32455  10K  RESISTOR_0201  [0201]
R32456  10K  RESISTOR_0201  [0201]
R32457  10K  RESISTOR_0201  [0201]
R32458  10K  RESISTOR_0201  [0201]
R32459  10K  RESISTOR_0201  [0201]
R32460  10K  RESISTOR_0201  [0201]
R32461  10K  RESISTOR_0201  [0201]
R32462  10K  RESISTOR_0201  [0201]
R32463  10K  RESISTOR_0201  [0201]
R32464  10K  RESISTOR_0201  [0201]
R32465  10K  RESISTOR_0201  [0201]
R32466  10K  RESISTOR_0201  [0201]
R32467  10K  RESISTOR_0201  [0201]
R32468  10K  RESISTOR_0201  [0201]
R32469  10K  RESISTOR_0201  [0201]
R32470  10K  RESISTOR_0201  [0201]
R32471  10K  RESISTOR_0201  [0201]
R32472  10K  RESISTOR_0201  [0201]
R32473  10K  RESISTOR_0201  [0201]
R32474  10K  RESISTOR_0201  [0201]
R32475  10K  RESISTOR_0201  [0201]
R32476  10K  RESISTOR_0201  [0201]
R32477  10K  RESISTOR_0201  [0201]
R32478  10K  RESISTOR_0201  [0201]
R32479  10K  RESISTOR_0201  [0201]
R32480  10K  RESISTOR_0201  [0201]
R32481  10K  RESISTOR_0201  [0201]
R32482  10K  RESISTOR_0201  [0201]
R32483  10K  RESISTOR_0201  [0201]
R32484  10K  RESISTOR_0201  [0201]
R32485  10K  RESISTOR_0201  [0201]
R32486  10K  RESISTOR_0201  [0201]
R32487  10K  RESISTOR_0201  [0201]
R32488  10K  RESISTOR_0201  [0201]
R32489  10K  RESISTOR_0201  [0201]
R32490  10K  RESISTOR_0201  [0201]
R32491  10K  RESISTOR_0201  [0201]
R32492  10K  RESISTOR_0201  [0201]
R32493  10K  RESISTOR_0201  [0201]
R32494  10K  RESISTOR_0201  [0201]
R32495  10K  RESISTOR_0201  [0201]
R32496  10K  RESISTOR_0201  [0201]
R32497  10K  RESISTOR_0201  [0201]
R32498  10K  RESISTOR_0201  [0201]
R32499  10K  RESISTOR_0201  [0201]
R32500  10K  RESISTOR_0201  [0201]
R32501  10K  RESISTOR_0201  [0201]
R32502  10K  RESISTOR_0201  [0201]
R32503  10K  RESISTOR_0201  [0201]
R32504  10K  RESISTOR_0201  [0201]
R32505  10K  RESISTOR_0201  [0201]
R32506  10K  RESISTOR_0201  [0201]
R32507  10K  RESISTOR_0201  [0201]
R32508  10K  RESISTOR_0201  [0201]
R32509  10K  RESISTOR_0201  [0201]
R32510  10K  RESISTOR_0201  [0201]
R32511  10K  RESISTOR_0201  [0201]
R32512  10K  RESISTOR_0201  [0201]
R32513  10K  RESISTOR_0201  [0201]
R32514  10K  RESISTOR_0201  [0201]
R32515  10K  RESISTOR_0201  [0201]
R32516  10K  RESISTOR_0201  [0201]
R32517  10K  RESISTOR_0201  [0201]
R32518  10K  RESISTOR_0201  [0201]
R32519  10K  RESISTOR_0201  [0201]
R32520  10K  RESISTOR_0201  [0201]
R32521  10K  RESISTOR_0201  [0201]
R32522  10K  RESISTOR_0201  [0201]
R32523  10K  RESISTOR_0201  [0201]
R32524  10K  RESISTOR_0201  [0201]
R32525  10K  RESISTOR_0201  [0201]
R32526  10K  RESISTOR_0201  [0201]
R32527  10K  RESISTOR_0201  [0201]
R32528  10K  RESISTOR_0201  [0201]
R32529  10K  RESISTOR_0201  [0201]
R32530  10K  RESISTOR_0201  [0201]
R32531  10K  RESISTOR_0201  [0201]
R32532  10K  RESISTOR_0201  [0201]
R32533  10K  RESISTOR_0201  [0201]
R32534  10K  RESISTOR_0201  [0201]
R32535  10K  RESISTOR_0201  [0201]
R32536  10K  RESISTOR_0201  [0201]
R32537  10K  RESISTOR_0201  [0201]
R32538  10K  RESISTOR_0201  [0201]
R32539  10K  RESISTOR_0201  [0201]
R32540  10K  RESISTOR_0201  [0201]
R32541  10K  RESISTOR_0201  [0201]
R32542  10K  RESISTOR_0201  [0201]
R32543  10K  RESISTOR_0201  [0201]
R32544  10K  RESISTOR_0201  [0201]
R32545  10K  RESISTOR_0201  [0201]
R32546  10K  RESISTOR_0201  [0201]
R32547  10K  RESISTOR_0201  [0201]
R32548  10K  RESISTOR_0201  [0201]
R32549  10K  RESISTOR_0201  [0201]
R32550  10K  RESISTOR_0201  [0201]
R32551  10K  RESISTOR_0201  [0201]
R32552  10K  RESISTOR_0201  [0201]
R32553  10K  RESISTOR_0201  [0201]
R32554  10K  RESISTOR_0201  [0201]
R32555  10K  RESISTOR_0201  [0201]
R32556  10K  RESISTOR_0201  [0201]
R32557  10K  RESISTOR_0201  [0201]
R32558  10K  RESISTOR_0201  [0201]
R32559  10K  RESISTOR_0201  [0201]
R32560  10K  RESISTOR_0201  [0201]
R32561  10K  RESISTOR_0201  [0201]
R32562  10K  RESISTOR_0201  [0201]
R32563  10K  RESISTOR_0201  [0201]
R32564  10K  RESISTOR_0201  [0201]
R32565  10K  RESISTOR_0201  [0201]
R32566  10K  RESISTOR_0201  [0201]
R32567  10K  RESISTOR_0201  [0201]
R32568  10K  RESISTOR_0201  [0201]
R32569  10K  RESISTOR_0201  [0201]
R32570  10K  RESISTOR_0201  [0201]
R32571  10K  RESISTOR_0201  [0201]
R32572  10K  RESISTOR_0201  [0201]
R32573  10K  RESISTOR_0201  [0201]
R32574  10K  RESISTOR_0201  [0201]
R32575  10K  RESISTOR_0201  [0201]
R32576  10K  RESISTOR_0201  [0201]
R32577  10K  RESISTOR_0201  [0201]
R32578  10K  RESISTOR_0201  [0201]
R32579  10K  RESISTOR_0201  [0201]
R32580  10K  RESISTOR_0201  [0201]
R32581  10K  RESISTOR_0201  [0201]
R32582  10K  RESISTOR_0201  [0201]
R32583  10K  RESISTOR_0201  [0201]
R32584  10K  RESISTOR_0201  [0201]
R32585  10K  RESISTOR_0201  [0201]
R32586  10K  RESISTOR_0201  [0201]
R32587  10K  RESISTOR_0201  [0201]
R32588  10K  RESISTOR_0201  [0201]
R32589  10K  RESISTOR_0201  [0201]
R32590  10K  RESISTOR_0201  [0201]
R32591  10K  RESISTOR_0201  [0201]
R32592  10K  RESISTOR_0201  [0201]
R32593  10K  RESISTOR_0201  [0201]
R32594  10K  RESISTOR_0201  [0201]
R32595  10K  RESISTOR_0201  [0201]
R32596  10K  RESISTOR_0201  [0201]
R32597  10K  RESISTOR_0201  [0201]
R32598  10K  RESISTOR_0201  [0201]
R32599  10K  RESISTOR_0201  [0201]
R32600  10K  RESISTOR_0201  [0201]
R32601  10K  RESISTOR_0201  [0201]
R32602  10K  RESISTOR_0201  [0201]
R32603  10K  RESISTOR_0201  [0201]
R32604  10K  RESISTOR_0201  [0201]
R32605  10K  RESISTOR_0201  [0201]
R32606  10K  RESISTOR_0201  [0201]
R32607  10K  RESISTOR_0201  [0201]
R32608  10K  RESISTOR_0201  [0201]
R32609  10K  RESISTOR_0201  [0201]
R32610  10K  RESISTOR_0201  [0201]
R32611  10K  RESISTOR_0201  [0201]
R32612  10K  RESISTOR_0201  [0201]
R32613  10K  RESISTOR_0201  [0201]
R32614  10K  RESISTOR_0201  [0201]
R32615  10K  RESISTOR_0201  [0201]
R32616  10K  RESISTOR_0201  [0201]
R32617  10K  RESISTOR_0201  [0201]
R32618  10K  RESISTOR_0201  [0201]
R32619  10K  RESISTOR_0201  [0201]
R32620  10K  RESISTOR_0201  [0201]
R32621  10K  RESISTOR_0201  [0201]
R32622  10K  RESISTOR_0201  [0201]
R32623  10K  RESISTOR_0201  [0201]
R32624  10K  RESISTOR_0201  [0201]
R32625  10K  RESISTOR_0201  [0201]
R32626  10K  RESISTOR_0201  [0201]
R32627  10K  RESISTOR_0201  [0201]
R32628  10K  RESISTOR_0201  [0201]
R32629  10K  RESISTOR_0201  [0201]
R32630  10K  RESISTOR_0201  [0201]
R32631  10K  RESISTOR_0201  [0201]
R32632  10K  RESISTOR_0201  [0201]
R32633  10K  RESISTOR_0201  [0201]
R32634  10K  RESISTOR_0201  [0201]
R32635  10K  RESISTOR_0201  [0201]
R32636  10K  RESISTOR_0201  [0201]
R32637  10K  RESISTOR_0201  [0201]
R32638  10K  RESISTOR_0201  [0201]
R32639  10K  RESISTOR_0201  [0201]
R32640  10K  RESISTOR_0201  [0201]
R32641  10K  RESISTOR_0201  [0201]
R32642  10K  RESISTOR_0201  [0201]
R32643  10K  RESISTOR_0201  [0201]
R32644  10K  RESISTOR_0201  [0201]
R32645  10K  RESISTOR_0201  [0201]
R32646  10K  RESISTOR_0201  [0201]
R32647  10K  RESISTOR_0201  [0201]
R32648  10K  RESISTOR_0201  [0201]
R32649  10K  RESISTOR_0201  [0201]
R32650  10K  RESISTOR_0201  [0201]
R32651  10K  RESISTOR_0201  [0201]
R32652  10K  RESISTOR_0201  [0201]
R32653  10K  RESISTOR_0201  [0201]
R32654  10K  RESISTOR_0201  [0201]
R32655  10K  RESISTOR_0201  [0201]
R32656  10K  RESISTOR_0201  [0201]
R32657  10K  RESISTOR_0201  [0201]
R32658  10K  RESISTOR_0201  [0201]
R32659  10K  RESISTOR_0201  [0201]
R32660  10K  RESISTOR_0201  [0201]
R32661  10K  RESISTOR_0201  [0201]
R32662  10K  RESISTOR_0201  [0201]
R32663  10K  RESISTOR_0201  [0201]
R32664  10K  RESISTOR_0201  [0201]
R32665  10K  RESISTOR_0201  [0201]
R32666  10K  RESISTOR_0201  [0201]
R32667  10K  RESISTOR_0201  [0201]
R32668  10K  RESISTOR_0201  [0201]
R32669  10K  RESISTOR_0201  [0201]
R32670  10K  RESISTOR_0201  [0201]
R32671  10K  RESISTOR_0201  [0201]
R32672  10K  RESISTOR_0201  [0201]
R32673  10K  RESISTOR_0201  [0201]
R32674  10K  RESISTOR_0201  [0201]
R32675  10K  RESISTOR_0201  [0201]
R32676  10K  RESISTOR_0201  [0201]
R32677  10K  RESISTOR_0201  [0201]
R32678  10K  RESISTOR_0201  [0201]
R32679  10K  RESISTOR_0201  [0201]
R32680  10K  RESISTOR_0201  [0201]
R32681  10K  RESISTOR_0201  [0201]
R32682  10K  RESISTOR_0201  [0201]
R32683  10K  RESISTOR_0201  [0201]
R32684  10K  RESISTOR_0201  [0201]
R32685  10K  RESISTOR_0201  [0201]
R32686  10K  RESISTOR_0201  [0201]
R32687  10K  RESISTOR_0201  [0201]
R32688  10K  RESISTOR_0201  [0201]
R32689  10K  RESISTOR_0201  [0201]
R32690  10K  RESISTOR_0201  [0201]
R32691  10K  RESISTOR_0201  [0201]
R32692  10K  RESISTOR_0201  [0201]
R32693  10K  RESISTOR_0201  [0201]
R32694  10K  RESISTOR_0201  [0201]
R32695  10K  RESISTOR_0201  [0201]
R32696  10K  RESISTOR_0201  [0201]
R32697  10K  RESISTOR_0201  [0201]
R32698  10K  RESISTOR_0201  [0201]
R32699  10K  RESISTOR_0201  [0201]
R32700  10K  RESISTOR_0201  [0201]
R32701  10K  RESISTOR_0201  [0201]
R32702  10K  RESISTOR_0201  [0201]
R32703  10K  RESISTOR_0201  [0201]
R32704  10K  RESISTOR_0201  [0201]
R32705  10K  RESISTOR_0201  [0201]
R32706  10K  RESISTOR_0201  [0201]
R32707  10K  RESISTOR_0201  [0201]
R32708  10K  RESISTOR_0201  [0201]
R32709  10K  RESISTOR_0201  [0201]
R32710  10K  RESISTOR_0201  [0201]
R32711  10K  RESISTOR_0201  [0201]
R32712  10K  RESISTOR_0201  [0201]
R32713  10K  RESISTOR_0201  [0201]
R32714  10K  RESISTOR_0201  [0201]
R32715  10K  RESISTOR_0201  [0201]
R32716  10K  RESISTOR_0201  [0201]
R32717  10K  RESISTOR_0201  [0201]
R32718  10K  RESISTOR_0201  [0201]
R32719  10K  RESISTOR_0201  [0201]
R32720  10K  RESISTOR_0201  [0201]
R32721  10K  RESISTOR_0201  [0201]
R32722  10K  RESISTOR_0201  [0201]
R32723  10K  RESISTOR_0201  [0201]
R32724  10K  RESISTOR_0201  [0201]
R32725  10K  RESISTOR_0201  [0201]
R32726  10K  RESISTOR_0201  [0201]
R32727  10K  RESISTOR_0201  [0201]
R32728  10K  RESISTOR_0201  [0201]
R32729  10K  RESISTOR_0201  [0201]
R32730  10K  RESISTOR_0201  [0201]
R32731  10K  RESISTOR_0201  [0201]
R32732  10K  RESISTOR_0201  [0201]
R32733  10K  RESISTOR_0201  [0201]
R32734  10K  RESISTOR_0201  [0201]
R32735  10K  RESISTOR_0201  [0201]
R32736  10K  RESISTOR_0201  [0201]
R32737  10K  RESISTOR_0201  [0201]
R32738  10K  RESISTOR_0201  [0201]
R32739  10K  RESISTOR_0201  [0201]
R32740  10K  RESISTOR_0201  [0201]
R32741  10K  RESISTOR_0201  [0201]
R32742  10K  RESISTOR_0201  [0201]
R32743  10K  RESISTOR_0201  [0201]
R32744  10K  RESISTOR_0201  [0201]
R32745  10K  RESISTOR_0201  [0201]
R32746  10K  RESISTOR_0201  [0201]
R32747  10K  RESISTOR_0201  [0201]
R32748  10K  RESISTOR_0201  [0201]
R32749  10K  RESISTOR_0201  [0201]
R32750  10K  RESISTOR_0201  [0201]
R32751  10K  RESISTOR_0201  [0201]
R32752  10K  RESISTOR_0201  [0201]
R32753  10K  RESISTOR_0201  [0201]
R32754  10K  RESISTOR_0201  [0201]
R32755  10K  RESISTOR_0201  [0201]
R32756  10K  RESISTOR_0201  [0201]
R32757  10K  RESISTOR_0201  [0201]
R32758  10K  RESISTOR_0201  [0201]
R32759  10K  RESISTOR_0201  [0201]
R32760  10K  RESISTOR_0201  [0201]
R32761  10K  RESISTOR_0201  [0201]
R32762  10K  RESISTOR_0201  [0201]
R32763  10K  RESISTOR_0201  [0201]
R32764  10K  RESISTOR_0201  [0201]
R32765  10K  RESISTOR_0201  [0201]
R32766  10K  RESISTOR_0201  [0201]
R32767  10K  RESISTOR_0201  [0201]
R32768  10K  RESISTOR_0201  [0201]
R32769  10K  RESISTOR_0201  [0201]
R32770  10K  RESISTOR_0201  [0201]
R32771  10K  RESISTOR_0201  [0201]
R32772  10K  RESISTOR_0201  [0201]
R32773  10K  RESISTOR_0201  [0201]
R32774  10K  RESISTOR_0201  [0201]
R32775  10K  RESISTOR_0201  [0201]
R32776  10K  RESISTOR_0201  [0201]
R32777  10K  RESISTOR_0201  [0201]
R32778  10K  RESISTOR_0201  [0201]
R32779  10K  RESISTOR_0201  [0201]
R32780  10K  RESISTOR_0201  [0201]
R32781  10K  RESISTOR_0201  [0201]
R32782  10K  RESISTOR_0201  [0201]
R32783  10K  RESISTOR_0201  [0201]
R32784  10K  RESISTOR_0201  [0201]
R32785  10K  RESISTOR_0201  [0201]
R32786  10K  RESISTOR_0201  [0201]
R32787  10K  RESISTOR_0201  [0201]
R32788  10K  RESISTOR_0201  [0201]
R32789  10K  RESISTOR_0201  [0201]
R32790  10K  RESISTOR_0201  [0201]
R32791  10K  RESISTOR_0201  [0201]
R32792  10K  RESISTOR_0201  [0201]
R32793  10K  RESISTOR_0201  [0201]
R32794  10K  RESISTOR_0201  [0201]
R32795  10K  RESISTOR_0201  [0201]
R32796  10K  RESISTOR_0201  [0201]
R32797  10K  RESISTOR_0201  [0201]
R32798  10K  RESISTOR_0201  [0201]
R32799  10K  RESISTOR_0201  [0201]
R32800  10K  RESISTOR_0201  [0201]
R32801  10K  RESISTOR_0201  [0201]
R32802  10K  RESISTOR_0201  [0201]
R32803  10K  RESISTOR_0201  [0201]
R32804  10K  RESISTOR_0201  [0201]
R32805  10K  RESISTOR_0201  [0201]
R32806  10K  RESISTOR_0201  [0201]
R32807  10K  RESISTOR_0201  [0201]
R32808  10K  RESISTOR_0201  [0201]
R32809  10K  RESISTOR_0201  [0201]
R32810  10K  RESISTOR_0201  [0201]
R32811  10K  RESISTOR_0201  [0201]
R32812  10K  RESISTOR_0201  [0201]
R32813  10K  RESISTOR_0201  [0201]
R32814  10K  RESISTOR_0201  [0201]
R32815  10K  RESISTOR_0201  [0201]
R32816  10K  RESISTOR_0201  [0201]
R32817  10K  RESISTOR_0201  [0201]
R32818  10K  RESISTOR_0201  [0201]
R32819  10K  RESISTOR_0201  [0201]
R32820  10K  RESISTOR_0201  [0201]
R32821  10K  RESISTOR_0201  [0201]
R32822  10K  RESISTOR_0201  [0201]
R32823  10K  RESISTOR_0201  [0201]
R32824  10K  RESISTOR_0201  [0201]
R32825  10K  RESISTOR_0201  [0201]
R32826  10K  RESISTOR_0201  [0201]
R32827  10K  RESISTOR_0201  [0201]
R32828  10K  RESISTOR_0201  [0201]
R32829  10K  RESISTOR_0201  [0201]
R32830  10K  RESISTOR_0201  [0201]
R32831  10K  RESISTOR_0201  [0201]
R32832  10K  RESISTOR_0201  [0201]
R32833  10K  RESISTOR_0201  [0201]
R32834  10K  RESISTOR_0201  [0201]
R32835  10K  RESISTOR_0201  [0201]
R32836  10K  RESISTOR_0201  [0201]
R32837  10K  RESISTOR_0201  [0201]
R32838  10K  RESISTOR_0201  [0201]
R32839  10K  RESISTOR_0201  [0201]
R32840  10K  RESISTOR_0201  [0201]
R32841  10K  RESISTOR_0201  [0201]
R32842  10K  RESISTOR_0201  [0201]
R32843  10K  RESISTOR_0201  [0201]
R32844  10K  RESISTOR_0201  [0201]
R32845  10K  RESISTOR_0201  [0201]
R32846  10K  RESISTOR_0201  [0201]
R32847  10K  RESISTOR_0201  [0201]
R32848  10K  RESISTOR_0201  [0201]
R32849  10K  RESISTOR_0201  [0201]
R32850  10K  RESISTOR_0201  [0201]
R32851  10K  RESISTOR_0201  [0201]
R32852  10K  RESISTOR_0201  [0201]
R32853  10K  RESISTOR_0201  [0201]
R32854  10K  RESISTOR_0201  [0201]
R32855  10K  RESISTOR_0201  [0201]
R32856  10K  RESISTOR_0201  [0201]
R32857  10K  RESISTOR_0201  [0201]
R32858  10K  RESISTOR_0201  [0201]
R32859  10K  RESISTOR_0201  [0201]
R32860  10K  RESISTOR_0201  [0201]
R32861  10K  RESISTOR_0201  [0201]
R32862  10K  RESISTOR_0201  [0201]
R32863  10K  RESISTOR_0201  [0201]
R32864  10K  RESISTOR_0201  [0201]
R32865  10K  RESISTOR_0201  [0201]
R32866  10K  RESISTOR_0201  [0201]
R32867  10K  RESISTOR_0201  [0201]
R32868  10K  RESISTOR_0201  [0201]
R32869  10K  RESISTOR_0201  [0201]
R32870  10K  RESISTOR_0201  [0201]
R32871  10K  RESISTOR_0201  [0201]
R32872  10K  RESISTOR_0201  [0201]
R32873  10K  RESISTOR_0201  [0201]
R32874  10K  RESISTOR_0201  [0201]
R32875  10K  RESISTOR_0201  [0201]
R32876  10K  RESISTOR_0201  [0201]
R32877  10K  RESISTOR_0201  [0201]
R32878  10K  RESISTOR_0201  [0201]
R32879  10K  RESISTOR_0201  [0201]
R32880  10K  RESISTOR_0201  [0201]
R32881  10K  RESISTOR_0201  [0201]
R32882  10K  RESISTOR_0201  [0201]
R32883  10K  RESISTOR_0201  [0201]
R32884  10K  RESISTOR_0201  [0201]
R32885  10K  RESISTOR_0201  [0201]
R32886  10K  RESISTOR_0201  [0201]
R32887  10K  RESISTOR_0201  [0201]
R32888  10K  RESISTOR_0201  [0201]
R32889  10K  RESISTOR_0201  [0201]
R32890  10K  RESISTOR_0201  [0201]
R32891  10K  RESISTOR_0201  [0201]
R32892  10K  RESISTOR_0201  [0201]
R32893  10K  RESISTOR_0201  [0201]
R32894  10K  RESISTOR_0201  [0201]
R32895  10K  RESISTOR_0201  [0201]
R32896  10K  RESISTOR_0201  [0201]
R32897  10K  RESISTOR_0201  [0201]
R32898  10K  RESISTOR_0201  [0201]
R32899  10K  RESISTOR_0201  [0201]
R32900  10K  RESISTOR_0201  [0201]
R32901  10K  RESISTOR_0201  [0201]
R32902  10K  RESISTOR_0201  [0201]
R32903  10K  RESISTOR_0201  [0201]
R32904  10K  RESISTOR_0201  [0201]
R32905  10K  RESISTOR_0201  [0201]
R32906  10K  RESISTOR_0201  [0201]
R32907  10K  RESISTOR_0201  [0201]
R32908  10K  RESISTOR_0201  [0201]
R32909  10K  RESISTOR_0201  [0201]
R32910  10K  RESISTOR_0201  [0201]
R32911  10K  RESISTOR_0201  [0201]
R32912  10K  RESISTOR_0201  [0201]
R32913  10K  RESISTOR_0201  [0201]
R32914  10K  RESISTOR_0201  [0201]
R32915  10K  RESISTOR_0201  [0201]
R32916  10K  RESISTOR_0201  [0201]
R32917  10K  RESISTOR_0201  [0201]
R32918  10K  RESISTOR_0201  [0201]
R32919  10K  RESISTOR_0201  [0201]
R32920  10K  RESISTOR_0201  [0201]
R32921  10K  RESISTOR_0201  [0201]
R32922  10K  RESISTOR_0201  [0201]
R32923  10K  RESISTOR_0201  [0201]
R32924  10K  RESISTOR_0201  [0201]
R32925  10K  RESISTOR_0201  [0201]
R32926  10K  RESISTOR_0201  [0201]
R32927  10K  RESISTOR_0201  [0201]
R32928  10K  RESISTOR_0201  [0201]
R32929  10K  RESISTOR_0201  [0201]
R32930  10K  RESISTOR_0201  [0201]
R32931  10K  RESISTOR_0201  [0201]
R32932  10K  RESISTOR_0201  [0201]
R32933  10K  RESISTOR_0201  [0201]
R32934  10K  RESISTOR_0201  [0201]
R32935  10K  RESISTOR_0201  [0201]
R32936  10K  RESISTOR_0201  [0201]
R32937  10K  RESISTOR_0201  [0201]
R32938  10K  RESISTOR_0201  [0201]
R32939  10K  RESISTOR_0201  [0201]
R32940  10K  RESISTOR_0201  [0201]
R32941  10K  RESISTOR_0201  [0201]
R32942  10K  RESISTOR_0201  [0201]
R32943  10K  RESISTOR_0201  [0201]
R32944  10K  RESISTOR_0201  [0201]
R32945  10K  RESISTOR_0201  [0201]
R32946  10K  RESISTOR_0201  [0201]
R32947  10K  RESISTOR_0201  [0201]
R32948  10K  RESISTOR_0201  [0201]
R32949  10K  RESISTOR_0201  [0201]
R32950  10K  RESISTOR_0201  [0201]
R32951  10K  RESISTOR_0201  [0201]
R32952  10K  RESISTOR_0201  [0201]
R32953  10K  RESISTOR_0201  [0201]
R32954  10K  RESISTOR_0201  [0201]
R32955  10K  RESISTOR_0201  [0201]
R32956  10K  RESISTOR_0201  [0201]
R32957  10K  RESISTOR_0201  [0201]